# EAGLE schematic Resistor_Resistor (EAGLE 8.3.0), part 37 of 43
## Nets (continued)
N$120: R22201.2 R22202.2 R22203.2 R22204.2 R22205.2 R22206.2 R22207.2 R22208.2 R22209.2 R22210.2 R22211.2 R22212.2 R22213.2 R22214.2 R22215.2 R22216.2 R22217.2 R22218.2 R22219.2 R22220.2 R22221.2 R22222.2 R22223.2 R22224.2 R22225.2 R22226.2 R22227.2 R22228.2 R22229.2 R22230.2 R22231.2 R22232.2 R22233.2 R22234.2 R22235.2 R22236.2 R22237.2 R22238.2 R22239.2 R22240.2 R22241.2 R22242.2 R22243.2 R22244.2 R22245.2 R22246.2 R22247.2 R22248.2 R22249.2 R22250.2 R22251.2 R22252.2 R22253.2 R22254.2 R22255.2 R22256.2 R22257.2 R22258.2 R22259.2 R22260.2 R22261.2 R22262.2 R22263.2 R22264.2 R22265.2 R22266.2 R22267.2 R22268.2 R22269.2 R22270.2 R22271.2 R22272.2 R22273.2 R22274.2 R22275.2 R22276.2 R22277.2 R22278.2 R22279.2 R22280.2 R22281.2 R22282.2 R22283.2 R22284.2 R22285.2 R22286.2 R22287.2 R22288.2 R22289.2 R22290.2 R22291.2 R22292.2 R22293.2 R22294.2 R22295.2 R22296.2 R22297.2 R22298.2 R22299.2 R22300.2 R22301.2 R22302.2 R22303.2 R22304.2 R22305.2 R22306.2 R22307.2 R22308.2 R22309.2 R22310.2 R22311.2 R22312.2 R22313.2 R22314.2 R22315.2 R22316.2 R22317.2 R22318.2 R22319.2 R22320.2 R22321.2 R22322.2 R22323.2 R22324.2 R22325.2 R22326.2 R22327.2 R22328.2 R22329.2 R22330.2 R22331.2 R22332.2 R22333.2 R22334.2 R22335.2 R22336.2 R22337.2 R22338.2 R22339.2 R22340.2 R22341.2 R22342.2 R22343.2 R22344.2 R22345.2 R22346.2 R22347.2 R22348.2 R22349.2 R22350.2 R22351.2 R22352.2 R22353.2 R22354.2 R22355.2 R22356.2 R22357.2 R22358.2 R22359.2 R22360.2 R22361.2 R22362.2 R22363.2 R22364.2 R22365.2 R22366.2 R22367.2 R22368.2 R22369.2 R22370.2 R22371.2 R22372.2 R22373.2 R22374.2 R22375.2 R22376.2 R22377.2 R22378.2 R22379.2 R22380.2 R22381.2 R22382.2 R22383.2 R22384.2 R22385.2 R22386.2 R22387.2 R22388.2 R22389.2 R22390.2 R22391.2 R22392.2 R22393.2 R22394.2 R22395.2 R22396.2 R22397.2 R22398.2 R22399.2 R22400.2 R22401.1 R22402.1 R22403.1 R22404.1 R22405.1 R22406.1 R22407.1 R22408.1 R22409.1 R22410.1 R22411.1 R22412.1 R22413.1 R22414.1 R22415.1 R22416.1 R22417.1 R22418.1 R22419.1 R22420.1 R22421.1 R22422.1 R22423.1 R22424.1 R22425.1 R22426.1 R22427.1 R22428.1 R22429.1 R22430.1 R22431.1 R22432.1 R22433.1 R22434.1 R22435.1 R22436.1 R22437.1 R22438.1 R22439.1 R22440.1 R22441.1 R22442.1 R22443.1 R22444.1 R22445.1 R22446.1 R22447.1 R22448.1 R22449.1 R22450.1 R22451.1 R22452.1 R22453.1 R22454.1 R22455.1 R22456.1 R22457.1 R22458.1 R22459.1 R22460.1 R22461.1 R22462.1 R22463.1 R22464.1 R22465.1 R22466.1 R22467.1 R22468.1 R22469.1 R22470.1 R22471.1 R22472.1 R22473.1 R22474.1 R22475.1 R22476.1 R22477.1 R22478.1 R22479.1 R22480.1 R22481.1 R22482.1 R22483.1 R22484.1 R22485.1 R22486.1 R22487.1 R22488.1 R22489.1 R22490.1 R22491.1 R22492.1 R22493.1 R22494.1 R22495.1 R22496.1 R22497.1 R22498.1 R22499.1 R22500.1 R22501.1 R22502.1 R22503.1 R22504.1 R22505.1 R22506.1 R22507.1 R22508.1 R22509.1 R22510.1 R22511.1 R22512.1 R22513.1 R22514.1 R22515.1 R22516.1 R22517.1 R22518.1 R22519.1 R22520.1 R22521.1 R22522.1 R22523.1 R22524.1 R22525.1 R22526.1 R22527.1 R22528.1 R22529.1 R22530.1 R22531.1 R22532.1 R22533.1 R22534.1 R22535.1 R22536.1 R22537.1 R22538.1 R22539.1 R22540.1 R22541.1 R22542.1 R22543.1 R22544.1 R22545.1 R22546.1 R22547.1 R22548.1 R22549.1 R22550.1 R22551.1 R22552.1 R22553.1 R22554.1 R22555.1 R22556.1 R22557.1 R22558.1 R22559.1 R22560.1 R22561.1 R22562.1 R22563.1 R22564.1 R22565.1 R22566.1 R22567.1 R22568.1 R22569.1 R22570.1 R22571.1 R22572.1 R22573.1 R22574.1 R22575.1 R22576.1 R22577.1 R22578.1 R22579.1 R22580.1 R22581.1 R22582.1 R22583.1 R22584.1 R22585.1 R22586.1 R22587.1 R22588.1 R22589.1 R22590.1 R22591.1 R22592.1 R22593.1 R22594.1 R22595.1 R22596.1 R22597.1 R22598.1 R22599.1 R22600.1
N$121: R22401.2 R22402.2 R22403.2 R22404.2 R22405.2 R22406.2 R22407.2 R22408.2 R22409.2 R22410.2 R22411.2 R22412.2 R22413.2 R22414.2 R22415.2 R22416.2 R22417.2 R22418.2 R22419.2 R22420.2 R22421.2 R22422.2 R22423.2 R22424.2 R22425.2 R22426.2 R22427.2 R22428.2 R22429.2 R22430.2 R22431.2 R22432.2 R22433.2 R22434.2 R22435.2 R22436.2 R22437.2 R22438.2 R22439.2 R22440.2 R22441.2 R22442.2 R22443.2 R22444.2 R22445.2 R22446.2 R22447.2 R22448.2 R22449.2 R22450.2 R22451.2 R22452.2 R22453.2 R22454.2 R22455.2 R22456.2 R22457.2 R22458.2 R22459.2 R22460.2 R22461.2 R22462.2 R22463.2 R22464.2 R22465.2 R22466.2 R22467.2 R22468.2 R22469.2 R22470.2 R22471.2 R22472.2 R22473.2 R22474.2 R22475.2 R22476.2 R22477.2 R22478.2 R22479.2 R22480.2 R22481.2 R22482.2 R22483.2 R22484.2 R22485.2 R22486.2 R22487.2 R22488.2 R22489.2 R22490.2 R22491.2 R22492.2 R22493.2 R22494.2 R22495.2 R22496.2 R22497.2 R22498.2 R22499.2 R22500.2 R22501.2 R22502.2 R22503.2 R22504.2 R22505.2 R22506.2 R22507.2 R22508.2 R22509.2 R22510.2 R22511.2 R22512.2 R22513.2 R22514.2 R22515.2 R22516.2 R22517.2 R22518.2 R22519.2 R22520.2 R22521.2 R22522.2 R22523.2 R22524.2 R22525.2 R22526.2 R22527.2 R22528.2 R22529.2 R22530.2 R22531.2 R22532.2 R22533.2 R22534.2 R22535.2 R22536.2 R22537.2 R22538.2 R22539.2 R22540.2 R22541.2 R22542.2 R22543.2 R22544.2 R22545.2 R22546.2 R22547.2 R22548.2 R22549.2 R22550.2 R22551.2 R22552.2 R22553.2 R22554.2 R22555.2 R22556.2 R22557.2 R22558.2 R22559.2 R22560.2 R22561.2 R22562.2 R22563.2 R22564.2 R22565.2 R22566.2 R22567.2 R22568.2 R22569.2 R22570.2 R22571.2 R22572.2 R22573.2 R22574.2 R22575.2 R22576.2 R22577.2 R22578.2 R22579.2 R22580.2 R22581.2 R22582.2 R22583.2 R22584.2 R22585.2 R22586.2 R22587.2 R22588.2 R22589.2 R22590.2 R22591.2 R22592.2 R22593.2 R22594.2 R22595.2 R22596.2 R22597.2 R22598.2 R22599.2 R22600.2 R22601.1 R22602.1 R22603.1 R22604.1 R22605.1 R22606.1 R22607.1 R22608.1 R22609.1 R22610.1 R22611.1 R22612.1 R22613.1 R22614.1 R22615.1 R22616.1 R22617.1 R22618.1 R22619.1 R22620.1 R22621.1 R22622.1 R22623.1 R22624.1 R22625.1 R22626.1 R22627.1 R22628.1 R22629.1 R22630.1 R22631.1 R22632.1 R22633.1 R22634.1 R22635.1 R22636.1 R22637.1 R22638.1 R22639.1 R22640.1 R22641.1 R22642.1 R22643.1 R22644.1 R22645.1 R22646.1 R22647.1 R22648.1 R22649.1 R22650.1 R22651.1 R22652.1 R22653.1 R22654.1 R22655.1 R22656.1 R22657.1 R22658.1 R22659.1 R22660.1 R22661.1 R22662.1 R22663.1 R22664.1 R22665.1 R22666.1 R22667.1 R22668.1 R22669.1 R22670.1 R22671.1 R22672.1 R22673.1 R22674.1 R22675.1 R22676.1 R22677.1 R22678.1 R22679.1 R22680.1 R22681.1 R22682.1 R22683.1 R22684.1 R22685.1 R22686.1 R22687.1 R22688.1 R22689.1 R22690.1 R22691.1 R22692.1 R22693.1 R22694.1 R22695.1 R22696.1 R22697.1 R22698.1 R22699.1 R22700.1 R22701.1 R22702.1 R22703.1 R22704.1 R22705.1 R22706.1 R22707.1 R22708.1 R22709.1 R22710.1 R22711.1 R22712.1 R22713.1 R22714.1 R22715.1 R22716.1 R22717.1 R22718.1 R22719.1 R22720.1 R22721.1 R22722.1 R22723.1 R22724.1 R22725.1 R22726.1 R22727.1 R22728.1 R22729.1 R22730.1 R22731.1 R22732.1 R22733.1 R22734.1 R22735.1 R22736.1 R22737.1 R22738.1 R22739.1 R22740.1 R22741.1 R22742.1 R22743.1 R22744.1 R22745.1 R22746.1 R22747.1 R22748.1 R22749.1 R22750.1 R22751.1 R22752.1 R22753.1 R22754.1 R22755.1 R22756.1 R22757.1 R22758.1 R22759.1 R22760.1 R22761.1 R22762.1 R22763.1 R22764.1 R22765.1 R22766.1 R22767.1 R22768.1 R22769.1 R22770.1 R22771.1 R22772.1 R22773.1 R22774.1 R22775.1 R22776.1 R22777.1 R22778.1 R22779.1 R22780.1 R22781.1 R22782.1 R22783.1 R22784.1 R22785.1 R22786.1 R22787.1 R22788.1 R22789.1 R22790.1 R22791.1 R22792.1 R22793.1 R22794.1 R22795.1 R22796.1 R22797.1 R22798.1 R22799.1 R22800.1
N$122: R22601.2 R22602.2 R22603.2 R22604.2 R22605.2 R22606.2 R22607.2 R22608.2 R22609.2 R22610.2 R22611.2 R22612.2 R22613.2 R22614.2 R22615.2 R22616.2 R22617.2 R22618.2 R22619.2 R22620.2 R22621.2 R22622.2 R22623.2 R22624.2 R22625.2 R22626.2 R22627.2 R22628.2 R22629.2 R22630.2 R22631.2 R22632.2 R22633.2 R22634.2 R22635.2 R22636.2 R22637.2 R22638.2 R22639.2 R22640.2 R22641.2 R22642.2 R22643.2 R22644.2 R22645.2 R22646.2 R22647.2 R22648.2 R22649.2 R22650.2 R22651.2 R22652.2 R22653.2 R22654.2 R22655.2 R22656.2 R22657.2 R22658.2 R22659.2 R22660.2 R22661.2 R22662.2 R22663.2 R22664.2 R22665.2 R22666.2 R22667.2 R22668.2 R22669.2 R22670.2 R22671.2 R22672.2 R22673.2 R22674.2 R22675.2 R22676.2 R22677.2 R22678.2 R22679.2 R22680.2 R22681.2 R22682.2 R22683.2 R22684.2 R22685.2 R22686.2 R22687.2 R22688.2 R22689.2 R22690.2 R22691.2 R22692.2 R22693.2 R22694.2 R22695.2 R22696.2 R22697.2 R22698.2 R22699.2 R22700.2 R22701.2 R22702.2 R22703.2 R22704.2 R22705.2 R22706.2 R22707.2 R22708.2 R22709.2 R22710.2 R22711.2 R22712.2 R22713.2 R22714.2 R22715.2 R22716.2 R22717.2 R22718.2 R22719.2 R22720.2 R22721.2 R22722.2 R22723.2 R22724.2 R22725.2 R22726.2 R22727.2 R22728.2 R22729.2 R22730.2 R22731.2 R22732.2 R22733.2 R22734.2 R22735.2 R22736.2 R22737.2 R22738.2 R22739.2 R22740.2 R22741.2 R22742.2 R22743.2 R22744.2 R22745.2 R22746.2 R22747.2 R22748.2 R22749.2 R22750.2 R22751.2 R22752.2 R22753.2 R22754.2 R22755.2 R22756.2 R22757.2 R22758.2 R22759.2 R22760.2 R22761.2 R22762.2 R22763.2 R22764.2 R22765.2 R22766.2 R22767.2 R22768.2 R22769.2 R22770.2 R22771.2 R22772.2 R22773.2 R22774.2 R22775.2 R22776.2 R22777.2 R22778.2 R22779.2 R22780.2 R22781.2 R22782.2 R22783.2 R22784.2 R22785.2 R22786.2 R22787.2 R22788.2 R22789.2 R22790.2 R22791.2 R22792.2 R22793.2 R22794.2 R22795.2 R22796.2 R22797.2 R22798.2 R22799.2 R22800.2 R22801.1 R22802.1 R22803.1 R22804.1 R22805.1 R22806.1 R22807.1 R22808.1 R22809.1 R22810.1 R22811.1 R22812.1 R22813.1 R22814.1 R22815.1 R22816.1 R22817.1 R22818.1 R22819.1 R22820.1 R22821.1 R22822.1 R22823.1 R22824.1 R22825.1 R22826.1 R22827.1 R22828.1 R22829.1 R22830.1 R22831.1 R22832.1 R22833.1 R22834.1 R22835.1 R22836.1 R22837.1 R22838.1 R22839.1 R22840.1 R22841.1 R22842.1 R22843.1 R22844.1 R22845.1 R22846.1 R22847.1 R22848.1 R22849.1 R22850.1 R22851.1 R22852.1 R22853.1 R22854.1 R22855.1 R22856.1 R22857.1 R22858.1 R22859.1 R22860.1 R22861.1 R22862.1 R22863.1 R22864.1 R22865.1 R22866.1 R22867.1 R22868.1 R22869.1 R22870.1 R22871.1 R22872.1 R22873.1 R22874.1 R22875.1 R22876.1 R22877.1 R22878.1 R22879.1 R22880.1 R22881.1 R22882.1 R22883.1 R22884.1 R22885.1 R22886.1 R22887.1 R22888.1 R22889.1 R22890.1 R22891.1 R22892.1 R22893.1 R22894.1 R22895.1 R22896.1 R22897.1 R22898.1 R22899.1 R22900.1 R22901.1 R22902.1 R22903.1 R22904.1 R22905.1 R22906.1 R22907.1 R22908.1 R22909.1 R22910.1 R22911.1 R22912.1 R22913.1 R22914.1 R22915.1 R22916.1 R22917.1 R22918.1 R22919.1 R22920.1 R22921.1 R22922.1 R22923.1 R22924.1 R22925.1 R22926.1 R22927.1 R22928.1 R22929.1 R22930.1 R22931.1 R22932.1 R22933.1 R22934.1 R22935.1 R22936.1 R22937.1 R22938.1 R22939.1 R22940.1 R22941.1 R22942.1 R22943.1 R22944.1 R22945.1 R22946.1 R22947.1 R22948.1 R22949.1 R22950.1 R22951.1 R22952.1 R22953.1 R22954.1 R22955.1 R22956.1 R22957.1 R22958.1 R22959.1 R22960.1 R22961.1 R22962.1 R22963.1 R22964.1 R22965.1 R22966.1 R22967.1 R22968.1 R22969.1 R22970.1 R22971.1 R22972.1 R22973.1 R22974.1 R22975.1 R22976.1 R22977.1 R22978.1 R22979.1 R22980.1 R22981.1 R22982.1 R22983.1 R22984.1 R22985.1 R22986.1 R22987.1 R22988.1 R22989.1 R22990.1 R22991.1 R22992.1 R22993.1 R22994.1 R22995.1 R22996.1 R22997.1 R22998.1 R22999.1 R23000.1
N$123: R22801.2 R22802.2 R22803.2 R22804.2 R22805.2 R22806.2 R22807.2 R22808.2 R22809.2 R22810.2 R22811.2 R22812.2 R22813.2 R22814.2 R22815.2 R22816.2 R22817.2 R22818.2 R22819.2 R22820.2 R22821.2 R22822.2 R22823.2 R22824.2 R22825.2 R22826.2 R22827.2 R22828.2 R22829.2 R22830.2 R22831.2 R22832.2 R22833.2 R22834.2 R22835.2 R22836.2 R22837.2 R22838.2 R22839.2 R22840.2 R22841.2 R22842.2 R22843.2 R22844.2 R22845.2 R22846.2 R22847.2 R22848.2 R22849.2 R22850.2 R22851.2 R22852.2 R22853.2 R22854.2 R22855.2 R22856.2 R22857.2 R22858.2 R22859.2 R22860.2 R22861.2 R22862.2 R22863.2 R22864.2 R22865.2 R22866.2 R22867.2 R22868.2 R22869.2 R22870.2 R22871.2 R22872.2 R22873.2 R22874.2 R22875.2 R22876.2 R22877.2 R22878.2 R22879.2 R22880.2 R22881.2 R22882.2 R22883.2 R22884.2 R22885.2 R22886.2 R22887.2 R22888.2 R22889.2 R22890.2 R22891.2 R22892.2 R22893.2 R22894.2 R22895.2 R22896.2 R22897.2 R22898.2 R22899.2 R22900.2 R22901.2 R22902.2 R22903.2 R22904.2 R22905.2 R22906.2 R22907.2 R22908.2 R22909.2 R22910.2 R22911.2 R22912.2 R22913.2 R22914.2 R22915.2 R22916.2 R22917.2 R22918.2 R22919.2 R22920.2 R22921.2 R22922.2 R22923.2 R22924.2 R22925.2 R22926.2 R22927.2 R22928.2 R22929.2 R22930.2 R22931.2 R22932.2 R22933.2 R22934.2 R22935.2 R22936.2 R22937.2 R22938.2 R22939.2 R22940.2 R22941.2 R22942.2 R22943.2 R22944.2 R22945.2 R22946.2 R22947.2 R22948.2 R22949.2 R22950.2 R22951.2 R22952.2 R22953.2 R22954.2 R22955.2 R22956.2 R22957.2 R22958.2 R22959.2 R22960.2 R22961.2 R22962.2 R22963.2 R22964.2 R22965.2 R22966.2 R22967.2 R22968.2 R22969.2 R22970.2 R22971.2 R22972.2 R22973.2 R22974.2 R22975.2 R22976.2 R22977.2 R22978.2 R22979.2 R22980.2 R22981.2 R22982.2 R22983.2 R22984.2 R22985.2 R22986.2 R22987.2 R22988.2 R22989.2 R22990.2 R22991.2 R22992.2 R22993.2 R22994.2 R22995.2 R22996.2 R22997.2 R22998.2 R22999.2 R23000.2 R23001.1 R23002.1 R23003.1 R23004.1 R23005.1 R23006.1 R23007.1 R23008.1 R23009.1 R23010.1 R23011.1 R23012.1 R23013.1 R23014.1 R23015.1 R23016.1 R23017.1 R23018.1 R23019.1 R23020.1 R23021.1 R23022.1 R23023.1 R23024.1 R23025.1 R23026.1 R23027.1 R23028.1 R23029.1 R23030.1 R23031.1 R23032.1 R23033.1 R23034.1 R23035.1 R23036.1 R23037.1 R23038.1 R23039.1 R23040.1 R23041.1 R23042.1 R23043.1 R23044.1 R23045.1 R23046.1 R23047.1 R23048.1 R23049.1 R23050.1 R23051.1 R23052.1 R23053.1 R23054.1 R23055.1 R23056.1 R23057.1 R23058.1 R23059.1 R23060.1 R23061.1 R23062.1 R23063.1 R23064.1 R23065.1 R23066.1 R23067.1 R23068.1 R23069.1 R23070.1 R23071.1 R23072.1 R23073.1 R23074.1 R23075.1 R23076.1 R23077.1 R23078.1 R23079.1 R23080.1 R23081.1 R23082.1 R23083.1 R23084.1 R23085.1 R23086.1 R23087.1 R23088.1 R23089.1 R23090.1 R23091.1 R23092.1 R23093.1 R23094.1 R23095.1 R23096.1 R23097.1 R23098.1 R23099.1 R23100.1 R23101.1 R23102.1 R23103.1 R23104.1 R23105.1 R23106.1 R23107.1 R23108.1 R23109.1 R23110.1 R23111.1 R23112.1 R23113.1 R23114.1 R23115.1 R23116.1 R23117.1 R23118.1 R23119.1 R23120.1 R23121.1 R23122.1 R23123.1 R23124.1 R23125.1 R23126.1 R23127.1 R23128.1 R23129.1 R23130.1 R23131.1 R23132.1 R23133.1 R23134.1 R23135.1 R23136.1 R23137.1 R23138.1 R23139.1 R23140.1 R23141.1 R23142.1 R23143.1 R23144.1 R23145.1 R23146.1 R23147.1 R23148.1 R23149.1 R23150.1 R23151.1 R23152.1 R23153.1 R23154.1 R23155.1 R23156.1 R23157.1 R23158.1 R23159.1 R23160.1 R23161.1 R23162.1 R23163.1 R23164.1 R23165.1 R23166.1 R23167.1 R23168.1 R23169.1 R23170.1 R23171.1 R23172.1 R23173.1 R23174.1 R23175.1 R23176.1 R23177.1 R23178.1 R23179.1 R23180.1 R23181.1 R23182.1 R23183.1 R23184.1 R23185.1 R23186.1 R23187.1 R23188.1 R23189.1 R23190.1 R23191.1 R23192.1 R23193.1 R23194.1 R23195.1 R23196.1 R23197.1 R23198.1 R23199.1 R23200.1
N$124: R23001.2 R23002.2 R23003.2 R23004.2 R23005.2 R23006.2 R23007.2 R23008.2 R23009.2 R23010.2 R23011.2 R23012.2 R23013.2 R23014.2 R23015.2 R23016.2 R23017.2 R23018.2 R23019.2 R23020.2 R23021.2 R23022.2 R23023.2 R23024.2 R23025.2 R23026.2 R23027.2 R23028.2 R23029.2 R23030.2 R23031.2 R23032.2 R23033.2 R23034.2 R23035.2 R23036.2 R23037.2 R23038.2 R23039.2 R23040.2 R23041.2 R23042.2 R23043.2 R23044.2 R23045.2 R23046.2 R23047.2 R23048.2 R23049.2 R23050.2 R23051.2 R23052.2 R23053.2 R23054.2 R23055.2 R23056.2 R23057.2 R23058.2 R23059.2 R23060.2 R23061.2 R23062.2 R23063.2 R23064.2 R23065.2 R23066.2 R23067.2 R23068.2 R23069.2 R23070.2 R23071.2 R23072.2 R23073.2 R23074.2 R23075.2 R23076.2 R23077.2 R23078.2 R23079.2 R23080.2 R23081.2 R23082.2 R23083.2 R23084.2 R23085.2 R23086.2 R23087.2 R23088.2 R23089.2 R23090.2 R23091.2 R23092.2 R23093.2 R23094.2 R23095.2 R23096.2 R23097.2 R23098.2 R23099.2 R23100.2 R23101.2 R23102.2 R23103.2 R23104.2 R23105.2 R23106.2 R23107.2 R23108.2 R23109.2 R23110.2 R23111.2 R23112.2 R23113.2 R23114.2 R23115.2 R23116.2 R23117.2 R23118.2 R23119.2 R23120.2 R23121.2 R23122.2 R23123.2 R23124.2 R23125.2 R23126.2 R23127.2 R23128.2 R23129.2 R23130.2 R23131.2 R23132.2 R23133.2 R23134.2 R23135.2 R23136.2 R23137.2 R23138.2 R23139.2 R23140.2 R23141.2 R23142.2 R23143.2 R23144.2 R23145.2 R23146.2 R23147.2 R23148.2 R23149.2 R23150.2 R23151.2 R23152.2 R23153.2 R23154.2 R23155.2 R23156.2 R23157.2 R23158.2 R23159.2 R23160.2 R23161.2 R23162.2 R23163.2 R23164.2 R23165.2 R23166.2 R23167.2 R23168.2 R23169.2 R23170.2 R23171.2 R23172.2 R23173.2 R23174.2 R23175.2 R23176.2 R23177.2 R23178.2 R23179.2 R23180.2 R23181.2 R23182.2 R23183.2 R23184.2 R23185.2 R23186.2 R23187.2 R23188.2 R23189.2 R23190.2 R23191.2 R23192.2 R23193.2 R23194.2 R23195.2 R23196.2 R23197.2 R23198.2 R23199.2 R23200.2 R23201.1 R23202.1 R23203.1 R23204.1 R23205.1 R23206.1 R23207.1 R23208.1 R23209.1 R23210.1 R23211.1 R23212.1 R23213.1 R23214.1 R23215.1 R23216.1 R23217.1 R23218.1 R23219.1 R23220.1 R23221.1 R23222.1 R23223.1 R23224.1 R23225.1 R23226.1 R23227.1 R23228.1 R23229.1 R23230.1 R23231.1 R23232.1 R23233.1 R23234.1 R23235.1 R23236.1 R23237.1 R23238.1 R23239.1 R23240.1 R23241.1 R23242.1 R23243.1 R23244.1 R23245.1 R23246.1 R23247.1 R23248.1 R23249.1 R23250.1 R23251.1 R23252.1 R23253.1 R23254.1 R23255.1 R23256.1 R23257.1 R23258.1 R23259.1 R23260.1 R23261.1 R23262.1 R23263.1 R23264.1 R23265.1 R23266.1 R23267.1 R23268.1 R23269.1 R23270.1 R23271.1 R23272.1 R23273.1 R23274.1 R23275.1 R23276.1 R23277.1 R23278.1 R23279.1 R23280.1 R23281.1 R23282.1 R23283.1 R23284.1 R23285.1 R23286.1 R23287.1 R23288.1 R23289.1 R23290.1 R23291.1 R23292.1 R23293.1 R23294.1 R23295.1 R23296.1 R23297.1 R23298.1 R23299.1 R23300.1 R23301.1 R23302.1 R23303.1 R23304.1 R23305.1 R23306.1 R23307.1 R23308.1 R23309.1 R23310.1 R23311.1 R23312.1 R23313.1 R23314.1 R23315.1 R23316.1 R23317.1 R23318.1 R23319.1 R23320.1 R23321.1 R23322.1 R23323.1 R23324.1 R23325.1 R23326.1 R23327.1 R23328.1 R23329.1 R23330.1 R23331.1 R23332.1 R23333.1 R23334.1 R23335.1 R23336.1 R23337.1 R23338.1 R23339.1 R23340.1 R23341.1 R23342.1 R23343.1 R23344.1 R23345.1 R23346.1 R23347.1 R23348.1 R23349.1 R23350.1 R23351.1 R23352.1 R23353.1 R23354.1 R23355.1 R23356.1 R23357.1 R23358.1 R23359.1 R23360.1 R23361.1 R23362.1 R23363.1 R23364.1 R23365.1 R23366.1 R23367.1 R23368.1 R23369.1 R23370.1 R23371.1 R23372.1 R23373.1 R23374.1 R23375.1 R23376.1 R23377.1 R23378.1 R23379.1 R23380.1 R23381.1 R23382.1 R23383.1 R23384.1 R23385.1 R23386.1 R23387.1 R23388.1 R23389.1 R23390.1 R23391.1 R23392.1 R23393.1 R23394.1 R23395.1 R23396.1 R23397.1 R23398.1 R23399.1 R23400.1
N$125: R23201.2 R23202.2 R23203.2 R23204.2 R23205.2 R23206.2 R23207.2 R23208.2 R23209.2 R23210.2 R23211.2 R23212.2 R23213.2 R23214.2 R23215.2 R23216.2 R23217.2 R23218.2 R23219.2 R23220.2 R23221.2 R23222.2 R23223.2 R23224.2 R23225.2 R23226.2 R23227.2 R23228.2 R23229.2 R23230.2 R23231.2 R23232.2 R23233.2 R23234.2 R23235.2 R23236.2 R23237.2 R23238.2 R23239.2 R23240.2 R23241.2 R23242.2 R23243.2 R23244.2 R23245.2 R23246.2 R23247.2 R23248.2 R23249.2 R23250.2 R23251.2 R23252.2 R23253.2 R23254.2 R23255.2 R23256.2 R23257.2 R23258.2 R23259.2 R23260.2 R23261.2 R23262.2 R23263.2 R23264.2 R23265.2 R23266.2 R23267.2 R23268.2 R23269.2 R23270.2 R23271.2 R23272.2 R23273.2 R23274.2 R23275.2 R23276.2 R23277.2 R23278.2 R23279.2 R23280.2 R23281.2 R23282.2 R23283.2 R23284.2 R23285.2 R23286.2 R23287.2 R23288.2 R23289.2 R23290.2 R23291.2 R23292.2 R23293.2 R23294.2 R23295.2 R23296.2 R23297.2 R23298.2 R23299.2 R23300.2 R23301.2 R23302.2 R23303.2 R23304.2 R23305.2 R23306.2 R23307.2 R23308.2 R23309.2 R23310.2 R23311.2 R23312.2 R23313.2 R23314.2 R23315.2 R23316.2 R23317.2 R23318.2 R23319.2 R23320.2 R23321.2 R23322.2 R23323.2 R23324.2 R23325.2 R23326.2 R23327.2 R23328.2 R23329.2 R23330.2 R23331.2 R23332.2 R23333.2 R23334.2 R23335.2 R23336.2 R23337.2 R23338.2 R23339.2 R23340.2 R23341.2 R23342.2 R23343.2 R23344.2 R23345.2 R23346.2 R23347.2 R23348.2 R23349.2 R23350.2 R23351.2 R23352.2 R23353.2 R23354.2 R23355.2 R23356.2 R23357.2 R23358.2 R23359.2 R23360.2 R23361.2 R23362.2 R23363.2 R23364.2 R23365.2 R23366.2 R23367.2 R23368.2 R23369.2 R23370.2 R23371.2 R23372.2 R23373.2 R23374.2 R23375.2 R23376.2 R23377.2 R23378.2 R23379.2 R23380.2 R23381.2 R23382.2 R23383.2 R23384.2 R23385.2 R23386.2 R23387.2 R23388.2 R23389.2 R23390.2 R23391.2 R23392.2 R23393.2 R23394.2 R23395.2 R23396.2 R23397.2 R23398.2 R23399.2 R23400.2 R23401.1 R23402.1 R23403.1 R23404.1 R23405.1 R23406.1 R23407.1 R23408.1 R23409.1 R23410.1 R23411.1 R23412.1 R23413.1 R23414.1 R23415.1 R23416.1 R23417.1 R23418.1 R23419.1 R23420.1 R23421.1 R23422.1 R23423.1 R23424.1 R23425.1 R23426.1 R23427.1 R23428.1 R23429.1 R23430.1 R23431.1 R23432.1 R23433.1 R23434.1 R23435.1 R23436.1 R23437.1 R23438.1 R23439.1 R23440.1 R23441.1 R23442.1 R23443.1 R23444.1 R23445.1 R23446.1 R23447.1 R23448.1 R23449.1 R23450.1 R23451.1 R23452.1 R23453.1 R23454.1 R23455.1 R23456.1 R23457.1 R23458.1 R23459.1 R23460.1 R23461.1 R23462.1 R23463.1 R23464.1 R23465.1 R23466.1 R23467.1 R23468.1 R23469.1 R23470.1 R23471.1 R23472.1 R23473.1 R23474.1 R23475.1 R23476.1 R23477.1 R23478.1 R23479.1 R23480.1 R23481.1 R23482.1 R23483.1 R23484.1 R23485.1 R23486.1 R23487.1 R23488.1 R23489.1 R23490.1 R23491.1 R23492.1 R23493.1 R23494.1 R23495.1 R23496.1 R23497.1 R23498.1 R23499.1 R23500.1 R23501.1 R23502.1 R23503.1 R23504.1 R23505.1 R23506.1 R23507.1 R23508.1 R23509.1 R23510.1 R23511.1 R23512.1 R23513.1 R23514.1 R23515.1 R23516.1 R23517.1 R23518.1 R23519.1 R23520.1 R23521.1 R23522.1 R23523.1 R23524.1 R23525.1 R23526.1 R23527.1 R23528.1 R23529.1 R23530.1 R23531.1 R23532.1 R23533.1 R23534.1 R23535.1 R23536.1 R23537.1 R23538.1 R23539.1 R23540.1 R23541.1 R23542.1 R23543.1 R23544.1 R23545.1 R23546.1 R23547.1 R23548.1 R23549.1 R23550.1 R23551.1 R23552.1 R23553.1 R23554.1 R23555.1 R23556.1 R23557.1 R23558.1 R23559.1 R23560.1 R23561.1 R23562.1 R23563.1 R23564.1 R23565.1 R23566.1 R23567.1 R23568.1 R23569.1 R23570.1 R23571.1 R23572.1 R23573.1 R23574.1 R23575.1 R23576.1 R23577.1 R23578.1 R23579.1 R23580.1 R23581.1 R23582.1 R23583.1 R23584.1 R23585.1 R23586.1 R23587.1 R23588.1 R23589.1 R23590.1 R23591.1 R23592.1 R23593.1 R23594.1 R23595.1 R23596.1 R23597.1 R23598.1 R23599.1 R23600.1
N$126: R23401.2 R23402.2 R23403.2 R23404.2 R23405.2 R23406.2 R23407.2 R23408.2 R23409.2 R23410.2 R23411.2 R23412.2 R23413.2 R23414.2 R23415.2 R23416.2 R23417.2 R23418.2 R23419.2 R23420.2 R23421.2 R23422.2 R23423.2 R23424.2 R23425.2 R23426.2 R23427.2 R23428.2 R23429.2 R23430.2 R23431.2 R23432.2 R23433.2 R23434.2 R23435.2 R23436.2 R23437.2 R23438.2 R23439.2 R23440.2 R23441.2 R23442.2 R23443.2 R23444.2 R23445.2 R23446.2 R23447.2 R23448.2 R23449.2 R23450.2 R23451.2 R23452.2 R23453.2 R23454.2 R23455.2 R23456.2 R23457.2 R23458.2 R23459.2 R23460.2 R23461.2 R23462.2 R23463.2 R23464.2 R23465.2 R23466.2 R23467.2 R23468.2 R23469.2 R23470.2 R23471.2 R23472.2 R23473.2 R23474.2 R23475.2 R23476.2 R23477.2 R23478.2 R23479.2 R23480.2 R23481.2 R23482.2 R23483.2 R23484.2 R23485.2 R23486.2 R23487.2 R23488.2 R23489.2 R23490.2 R23491.2 R23492.2 R23493.2 R23494.2 R23495.2 R23496.2 R23497.2 R23498.2 R23499.2 R23500.2 R23501.2 R23502.2 R23503.2 R23504.2 R23505.2 R23506.2 R23507.2 R23508.2 R23509.2 R23510.2 R23511.2 R23512.2 R23513.2 R23514.2 R23515.2 R23516.2 R23517.2 R23518.2 R23519.2 R23520.2 R23521.2 R23522.2 R23523.2 R23524.2 R23525.2 R23526.2 R23527.2 R23528.2 R23529.2 R23530.2 R23531.2 R23532.2 R23533.2 R23534.2 R23535.2 R23536.2 R23537.2 R23538.2 R23539.2 R23540.2 R23541.2 R23542.2 R23543.2 R23544.2 R23545.2 R23546.2 R23547.2 R23548.2 R23549.2 R23550.2 R23551.2 R23552.2 R23553.2 R23554.2 R23555.2 R23556.2 R23557.2 R23558.2 R23559.2 R23560.2 R23561.2 R23562.2 R23563.2 R23564.2 R23565.2 R23566.2 R23567.2 R23568.2 R23569.2 R23570.2 R23571.2 R23572.2 R23573.2 R23574.2 R23575.2 R23576.2 R23577.2 R23578.2 R23579.2 R23580.2 R23581.2 R23582.2 R23583.2 R23584.2 R23585.2 R23586.2 R23587.2 R23588.2 R23589.2 R23590.2 R23591.2 R23592.2 R23593.2 R23594.2 R23595.2 R23596.2 R23597.2 R23598.2 R23599.2 R23600.2 R23601.1 R23602.1 R23603.1 R23604.1 R23605.1 R23606.1 R23607.1 R23608.1 R23609.1 R23610.1 R23611.1 R23612.1 R23613.1 R23614.1 R23615.1 R23616.1 R23617.1 R23618.1 R23619.1 R23620.1 R23621.1 R23622.1 R23623.1 R23624.1 R23625.1 R23626.1 R23627.1 R23628.1 R23629.1 R23630.1 R23631.1 R23632.1 R23633.1 R23634.1 R23635.1 R23636.1 R23637.1 R23638.1 R23639.1 R23640.1 R23641.1 R23642.1 R23643.1 R23644.1 R23645.1 R23646.1 R23647.1 R23648.1 R23649.1 R23650.1 R23651.1 R23652.1 R23653.1 R23654.1 R23655.1 R23656.1 R23657.1 R23658.1 R23659.1 R23660.1 R23661.1 R23662.1 R23663.1 R23664.1 R23665.1 R23666.1 R23667.1 R23668.1 R23669.1 R23670.1 R23671.1 R23672.1 R23673.1 R23674.1 R23675.1 R23676.1 R23677.1 R23678.1 R23679.1 R23680.1 R23681.1 R23682.1 R23683.1 R23684.1 R23685.1 R23686.1 R23687.1 R23688.1 R23689.1 R23690.1 R23691.1 R23692.1 R23693.1 R23694.1 R23695.1 R23696.1 R23697.1 R23698.1 R23699.1 R23700.1 R23701.1 R23702.1 R23703.1 R23704.1 R23705.1 R23706.1 R23707.1 R23708.1 R23709.1 R23710.1 R23711.1 R23712.1 R23713.1 R23714.1 R23715.1 R23716.1 R23717.1 R23718.1 R23719.1 R23720.1 R23721.1 R23722.1 R23723.1 R23724.1 R23725.1 R23726.1 R23727.1 R23728.1 R23729.1 R23730.1 R23731.1 R23732.1 R23733.1 R23734.1 R23735.1 R23736.1 R23737.1 R23738.1 R23739.1 R23740.1 R23741.1 R23742.1 R23743.1 R23744.1 R23745.1 R23746.1 R23747.1 R23748.1 R23749.1 R23750.1 R23751.1 R23752.1 R23753.1 R23754.1 R23755.1 R23756.1 R23757.1 R23758.1 R23759.1 R23760.1 R23761.1 R23762.1 R23763.1 R23764.1 R23765.1 R23766.1 R23767.1 R23768.1 R23769.1 R23770.1 R23771.1 R23772.1 R23773.1 R23774.1 R23775.1 R23776.1 R23777.1 R23778.1 R23779.1 R23780.1 R23781.1 R23782.1 R23783.1 R23784.1 R23785.1 R23786.1 R23787.1 R23788.1 R23789.1 R23790.1 R23791.1 R23792.1 R23793.1 R23794.1 R23795.1 R23796.1 R23797.1 R23798.1 R23799.1 R23800.1
N$127: R23601.2 R23602.2 R23603.2 R23604.2 R23605.2 R23606.2 R23607.2 R23608.2 R23609.2 R23610.2 R23611.2 R23612.2 R23613.2 R23614.2 R23615.2 R23616.2 R23617.2 R23618.2 R23619.2 R23620.2 R23621.2 R23622.2 R23623.2 R23624.2 R23625.2 R23626.2 R23627.2 R23628.2 R23629.2 R23630.2 R23631.2 R23632.2 R23633.2 R23634.2 R23635.2 R23636.2 R23637.2 R23638.2 R23639.2 R23640.2 R23641.2 R23642.2 R23643.2 R23644.2 R23645.2 R23646.2 R23647.2 R23648.2 R23649.2 R23650.2 R23651.2 R23652.2 R23653.2 R23654.2 R23655.2 R23656.2 R23657.2 R23658.2 R23659.2 R23660.2 R23661.2 R23662.2 R23663.2 R23664.2 R23665.2 R23666.2 R23667.2 R23668.2 R23669.2 R23670.2 R23671.2 R23672.2 R23673.2 R23674.2 R23675.2 R23676.2 R23677.2 R23678.2 R23679.2 R23680.2 R23681.2 R23682.2 R23683.2 R23684.2 R23685.2 R23686.2 R23687.2 R23688.2 R23689.2 R23690.2 R23691.2 R23692.2 R23693.2 R23694.2 R23695.2 R23696.2 R23697.2 R23698.2 R23699.2 R23700.2 R23701.2 R23702.2 R23703.2 R23704.2 R23705.2 R23706.2 R23707.2 R23708.2 R23709.2 R23710.2 R23711.2 R23712.2 R23713.2 R23714.2 R23715.2 R23716.2 R23717.2 R23718.2 R23719.2 R23720.2 R23721.2 R23722.2 R23723.2 R23724.2 R23725.2 R23726.2 R23727.2 R23728.2 R23729.2 R23730.2 R23731.2 R23732.2 R23733.2 R23734.2 R23735.2 R23736.2 R23737.2 R23738.2 R23739.2 R23740.2 R23741.2 R23742.2 R23743.2 R23744.2 R23745.2 R23746.2 R23747.2 R23748.2 R23749.2 R23750.2 R23751.2 R23752.2 R23753.2 R23754.2 R23755.2 R23756.2 R23757.2 R23758.2 R23759.2 R23760.2 R23761.2 R23762.2 R23763.2 R23764.2 R23765.2 R23766.2 R23767.2 R23768.2 R23769.2 R23770.2 R23771.2 R23772.2 R23773.2 R23774.2 R23775.2 R23776.2 R23777.2 R23778.2 R23779.2 R23780.2 R23781.2 R23782.2 R23783.2 R23784.2 R23785.2 R23786.2 R23787.2 R23788.2 R23789.2 R23790.2 R23791.2 R23792.2 R23793.2 R23794.2 R23795.2 R23796.2 R23797.2 R23798.2 R23799.2 R23800.2 R23801.1 R23802.1 R23803.1 R23804.1 R23805.1 R23806.1 R23807.1 R23808.1 R23809.1 R23810.1 R23811.1 R23812.1 R23813.1 R23814.1 R23815.1 R23816.1 R23817.1 R23818.1 R23819.1 R23820.1 R23821.1 R23822.1 R23823.1 R23824.1 R23825.1 R23826.1 R23827.1 R23828.1 R23829.1 R23830.1 R23831.1 R23832.1 R23833.1 R23834.1 R23835.1 R23836.1 R23837.1 R23838.1 R23839.1 R23840.1 R23841.1 R23842.1 R23843.1 R23844.1 R23845.1 R23846.1 R23847.1 R23848.1 R23849.1 R23850.1 R23851.1 R23852.1 R23853.1 R23854.1 R23855.1 R23856.1 R23857.1 R23858.1 R23859.1 R23860.1 R23861.1 R23862.1 R23863.1 R23864.1 R23865.1 R23866.1 R23867.1 R23868.1 R23869.1 R23870.1 R23871.1 R23872.1 R23873.1 R23874.1 R23875.1 R23876.1 R23877.1 R23878.1 R23879.1 R23880.1 R23881.1 R23882.1 R23883.1 R23884.1 R23885.1 R23886.1 R23887.1 R23888.1 R23889.1 R23890.1 R23891.1 R23892.1 R23893.1 R23894.1 R23895.1 R23896.1 R23897.1 R23898.1 R23899.1 R23900.1 R23901.1 R23902.1 R23903.1 R23904.1 R23905.1 R23906.1 R23907.1 R23908.1 R23909.1 R23910.1 R23911.1 R23912.1 R23913.1 R23914.1 R23915.1 R23916.1 R23917.1 R23918.1 R23919.1 R23920.1 R23921.1 R23922.1 R23923.1 R23924.1 R23925.1 R23926.1 R23927.1 R23928.1 R23929.1 R23930.1 R23931.1 R23932.1 R23933.1 R23934.1 R23935.1 R23936.1 R23937.1 R23938.1 R23939.1 R23940.1 R23941.1 R23942.1 R23943.1 R23944.1 R23945.1 R23946.1 R23947.1 R23948.1 R23949.1 R23950.1 R23951.1 R23952.1 R23953.1 R23954.1 R23955.1 R23956.1 R23957.1 R23958.1 R23959.1 R23960.1 R23961.1 R23962.1 R23963.1 R23964.1 R23965.1 R23966.1 R23967.1 R23968.1 R23969.1 R23970.1 R23971.1 R23972.1 R23973.1 R23974.1 R23975.1 R23976.1 R23977.1 R23978.1 R23979.1 R23980.1 R23981.1 R23982.1 R23983.1 R23984.1 R23985.1 R23986.1 R23987.1 R23988.1 R23989.1 R23990.1 R23991.1 R23992.1 R23993.1 R23994.1 R23995.1 R23996.1 R23997.1 R23998.1 R23999.1 R24000.1
N$128: R23801.2 R23802.2 R23803.2 R23804.2 R23805.2 R23806.2 R23807.2 R23808.2 R23809.2 R23810.2 R23811.2 R23812.2 R23813.2 R23814.2 R23815.2 R23816.2 R23817.2 R23818.2 R23819.2 R23820.2 R23821.2 R23822.2 R23823.2 R23824.2 R23825.2 R23826.2 R23827.2 R23828.2 R23829.2 R23830.2 R23831.2 R23832.2 R23833.2 R23834.2 R23835.2 R23836.2 R23837.2 R23838.2 R23839.2 R23840.2 R23841.2 R23842.2 R23843.2 R23844.2 R23845.2 R23846.2 R23847.2 R23848.2 R23849.2 R23850.2 R23851.2 R23852.2 R23853.2 R23854.2 R23855.2 R23856.2 R23857.2 R23858.2 R23859.2 R23860.2 R23861.2 R23862.2 R23863.2 R23864.2 R23865.2 R23866.2 R23867.2 R23868.2 R23869.2 R23870.2 R23871.2 R23872.2 R23873.2 R23874.2 R23875.2 R23876.2 R23877.2 R23878.2 R23879.2 R23880.2 R23881.2 R23882.2 R23883.2 R23884.2 R23885.2 R23886.2 R23887.2 R23888.2 R23889.2 R23890.2 R23891.2 R23892.2 R23893.2 R23894.2 R23895.2 R23896.2 R23897.2 R23898.2 R23899.2 R23900.2 R23901.2 R23902.2 R23903.2 R23904.2 R23905.2 R23906.2 R23907.2 R23908.2 R23909.2 R23910.2 R23911.2 R23912.2 R23913.2 R23914.2 R23915.2 R23916.2 R23917.2 R23918.2 R23919.2 R23920.2 R23921.2 R23922.2 R23923.2 R23924.2 R23925.2 R23926.2 R23927.2 R23928.2 R23929.2 R23930.2 R23931.2 R23932.2 R23933.2 R23934.2 R23935.2 R23936.2 R23937.2 R23938.2 R23939.2 R23940.2 R23941.2 R23942.2 R23943.2 R23944.2 R23945.2 R23946.2 R23947.2 R23948.2 R23949.2 R23950.2 R23951.2 R23952.2 R23953.2 R23954.2 R23955.2 R23956.2 R23957.2 R23958.2 R23959.2 R23960.2 R23961.2 R23962.2 R23963.2 R23964.2 R23965.2 R23966.2 R23967.2 R23968.2 R23969.2 R23970.2 R23971.2 R23972.2 R23973.2 R23974.2 R23975.2 R23976.2 R23977.2 R23978.2 R23979.2 R23980.2 R23981.2 R23982.2 R23983.2 R23984.2 R23985.2 R23986.2 R23987.2 R23988.2 R23989.2 R23990.2 R23991.2 R23992.2 R23993.2 R23994.2 R23995.2 R23996.2 R23997.2 R23998.2 R23999.2 R24000.2 R24001.1 R24002.1 R24003.1 R24004.1 R24005.1 R24006.1 R24007.1 R24008.1 R24009.1 R24010.1 R24011.1 R24012.1 R24013.1 R24014.1 R24015.1 R24016.1 R24017.1 R24018.1 R24019.1 R24020.1 R24021.1 R24022.1 R24023.1 R24024.1 R24025.1 R24026.1 R24027.1 R24028.1 R24029.1 R24030.1 R24031.1 R24032.1 R24033.1 R24034.1 R24035.1 R24036.1 R24037.1 R24038.1 R24039.1 R24040.1 R24041.1 R24042.1 R24043.1 R24044.1 R24045.1 R24046.1 R24047.1 R24048.1 R24049.1 R24050.1 R24051.1 R24052.1 R24053.1 R24054.1 R24055.1 R24056.1 R24057.1 R24058.1 R24059.1 R24060.1 R24061.1 R24062.1 R24063.1 R24064.1 R24065.1 R24066.1 R24067.1 R24068.1 R24069.1 R24070.1 R24071.1 R24072.1 R24073.1 R24074.1 R24075.1 R24076.1 R24077.1 R24078.1 R24079.1 R24080.1 R24081.1 R24082.1 R24083.1 R24084.1 R24085.1 R24086.1 R24087.1 R24088.1 R24089.1 R24090.1 R24091.1 R24092.1 R24093.1 R24094.1 R24095.1 R24096.1 R24097.1 R24098.1 R24099.1 R24100.1 R24101.1 R24102.1 R24103.1 R24104.1 R24105.1 R24106.1 R24107.1 R24108.1 R24109.1 R24110.1 R24111.1 R24112.1 R24113.1 R24114.1 R24115.1 R24116.1 R24117.1 R24118.1 R24119.1 R24120.1 R24121.1 R24122.1 R24123.1 R24124.1 R24125.1 R24126.1 R24127.1 R24128.1 R24129.1 R24130.1 R24131.1 R24132.1 R24133.1 R24134.1 R24135.1 R24136.1 R24137.1 R24138.1 R24139.1 R24140.1 R24141.1 R24142.1 R24143.1 R24144.1 R24145.1 R24146.1 R24147.1 R24148.1 R24149.1 R24150.1 R24151.1 R24152.1 R24153.1 R24154.1 R24155.1 R24156.1 R24157.1 R24158.1 R24159.1 R24160.1 R24161.1 R24162.1 R24163.1 R24164.1 R24165.1 R24166.1 R24167.1 R24168.1 R24169.1 R24170.1 R24171.1 R24172.1 R24173.1 R24174.1 R24175.1 R24176.1 R24177.1 R24178.1 R24179.1 R24180.1 R24181.1 R24182.1 R24183.1 R24184.1 R24185.1 R24186.1 R24187.1 R24188.1 R24189.1 R24190.1 R24191.1 R24192.1 R24193.1 R24194.1 R24195.1 R24196.1 R24197.1 R24198.1 R24199.1 R24200.1
N$129: R24001.2 R24002.2 R24003.2 R24004.2 R24005.2 R24006.2 R24007.2 R24008.2 R24009.2 R24010.2 R24011.2 R24012.2 R24013.2 R24014.2 R24015.2 R24016.2 R24017.2 R24018.2 R24019.2 R24020.2 R24021.2 R24022.2 R24023.2 R24024.2 R24025.2 R24026.2 R24027.2 R24028.2 R24029.2 R24030.2 R24031.2 R24032.2 R24033.2 R24034.2 R24035.2 R24036.2 R24037.2 R24038.2 R24039.2 R24040.2 R24041.2 R24042.2 R24043.2 R24044.2 R24045.2 R24046.2 R24047.2 R24048.2 R24049.2 R24050.2 R24051.2 R24052.2 R24053.2 R24054.2 R24055.2 R24056.2 R24057.2 R24058.2 R24059.2 R24060.2 R24061.2 R24062.2 R24063.2 R24064.2 R24065.2 R24066.2 R24067.2 R24068.2 R24069.2 R24070.2 R24071.2 R24072.2 R24073.2 R24074.2 R24075.2 R24076.2 R24077.2 R24078.2 R24079.2 R24080.2 R24081.2 R24082.2 R24083.2 R24084.2 R24085.2 R24086.2 R24087.2 R24088.2 R24089.2 R24090.2 R24091.2 R24092.2 R24093.2 R24094.2 R24095.2 R24096.2 R24097.2 R24098.2 R24099.2 R24100.2 R24101.2 R24102.2 R24103.2 R24104.2 R24105.2 R24106.2 R24107.2 R24108.2 R24109.2 R24110.2 R24111.2 R24112.2 R24113.2 R24114.2 R24115.2 R24116.2 R24117.2 R24118.2 R24119.2 R24120.2 R24121.2 R24122.2 R24123.2 R24124.2 R24125.2 R24126.2 R24127.2 R24128.2 R24129.2 R24130.2 R24131.2 R24132.2 R24133.2 R24134.2 R24135.2 R24136.2 R24137.2 R24138.2 R24139.2 R24140.2 R24141.2 R24142.2 R24143.2 R24144.2 R24145.2 R24146.2 R24147.2 R24148.2 R24149.2 R24150.2 R24151.2 R24152.2 R24153.2 R24154.2 R24155.2 R24156.2 R24157.2 R24158.2 R24159.2 R24160.2 R24161.2 R24162.2 R24163.2 R24164.2 R24165.2 R24166.2 R24167.2 R24168.2 R24169.2 R24170.2 R24171.2 R24172.2 R24173.2 R24174.2 R24175.2 R24176.2 R24177.2 R24178.2 R24179.2 R24180.2 R24181.2 R24182.2 R24183.2 R24184.2 R24185.2 R24186.2 R24187.2 R24188.2 R24189.2 R24190.2 R24191.2 R24192.2 R24193.2 R24194.2 R24195.2 R24196.2 R24197.2 R24198.2 R24199.2 R24200.2 R24201.1 R24202.1 R24203.1 R24204.1 R24205.1 R24206.1 R24207.1 R24208.1 R24209.1 R24210.1 R24211.1 R24212.1 R24213.1 R24214.1 R24215.1 R24216.1 R24217.1 R24218.1 R24219.1 R24220.1 R24221.1 R24222.1 R24223.1 R24224.1 R24225.1 R24226.1 R24227.1 R24228.1 R24229.1 R24230.1 R24231.1 R24232.1 R24233.1 R24234.1 R24235.1 R24236.1 R24237.1 R24238.1 R24239.1 R24240.1 R24241.1 R24242.1 R24243.1 R24244.1 R24245.1 R24246.1 R24247.1 R24248.1 R24249.1 R24250.1 R24251.1 R24252.1 R24253.1 R24254.1 R24255.1 R24256.1 R24257.1 R24258.1 R24259.1 R24260.1 R24261.1 R24262.1 R24263.1 R24264.1 R24265.1 R24266.1 R24267.1 R24268.1 R24269.1 R24270.1 R24271.1 R24272.1 R24273.1 R24274.1 R24275.1 R24276.1 R24277.1 R24278.1 R24279.1 R24280.1 R24281.1 R24282.1 R24283.1 R24284.1 R24285.1 R24286.1 R24287.1 R24288.1 R24289.1 R24290.1 R24291.1 R24292.1 R24293.1 R24294.1 R24295.1 R24296.1 R24297.1 R24298.1 R24299.1 R24300.1 R24301.1 R24302.1 R24303.1 R24304.1 R24305.1 R24306.1 R24307.1 R24308.1 R24309.1 R24310.1 R24311.1 R24312.1 R24313.1 R24314.1 R24315.1 R24316.1 R24317.1 R24318.1 R24319.1 R24320.1 R24321.1 R24322.1 R24323.1 R24324.1 R24325.1 R24326.1 R24327.1 R24328.1 R24329.1 R24330.1 R24331.1 R24332.1 R24333.1 R24334.1 R24335.1 R24336.1 R24337.1 R24338.1 R24339.1 R24340.1 R24341.1 R24342.1 R24343.1 R24344.1 R24345.1 R24346.1 R24347.1 R24348.1 R24349.1 R24350.1 R24351.1 R24352.1 R24353.1 R24354.1 R24355.1 R24356.1 R24357.1 R24358.1 R24359.1 R24360.1 R24361.1 R24362.1 R24363.1 R24364.1 R24365.1 R24366.1 R24367.1 R24368.1 R24369.1 R24370.1 R24371.1 R24372.1 R24373.1 R24374.1 R24375.1 R24376.1 R24377.1 R24378.1 R24379.1 R24380.1 R24381.1 R24382.1 R24383.1 R24384.1 R24385.1 R24386.1 R24387.1 R24388.1 R24389.1 R24390.1 R24391.1 R24392.1 R24393.1 R24394.1 R24395.1 R24396.1 R24397.1 R24398.1 R24399.1 R24400.1
N$130: R24201.2 R24202.2 R24203.2 R24204.2 R24205.2 R24206.2 R24207.2 R24208.2 R24209.2 R24210.2 R24211.2 R24212.2 R24213.2 R24214.2 R24215.2 R24216.2 R24217.2 R24218.2 R24219.2 R24220.2 R24221.2 R24222.2 R24223.2 R24224.2 R24225.2 R24226.2 R24227.2 R24228.2 R24229.2 R24230.2 R24231.2 R24232.2 R24233.2 R24234.2 R24235.2 R24236.2 R24237.2 R24238.2 R24239.2 R24240.2 R24241.2 R24242.2 R24243.2 R24244.2 R24245.2 R24246.2 R24247.2 R24248.2 R24249.2 R24250.2 R24251.2 R24252.2 R24253.2 R24254.2 R24255.2 R24256.2 R24257.2 R24258.2 R24259.2 R24260.2 R24261.2 R24262.2 R24263.2 R24264.2 R24265.2 R24266.2 R24267.2 R24268.2 R24269.2 R24270.2 R24271.2 R24272.2 R24273.2 R24274.2 R24275.2 R24276.2 R24277.2 R24278.2 R24279.2 R24280.2 R24281.2 R24282.2 R24283.2 R24284.2 R24285.2 R24286.2 R24287.2 R24288.2 R24289.2 R24290.2 R24291.2 R24292.2 R24293.2 R24294.2 R24295.2 R24296.2 R24297.2 R24298.2 R24299.2 R24300.2 R24301.2 R24302.2 R24303.2 R24304.2 R24305.2 R24306.2 R24307.2 R24308.2 R24309.2 R24310.2 R24311.2 R24312.2 R24313.2 R24314.2 R24315.2 R24316.2 R24317.2 R24318.2 R24319.2 R24320.2 R24321.2 R24322.2 R24323.2 R24324.2 R24325.2 R24326.2 R24327.2 R24328.2 R24329.2 R24330.2 R24331.2 R24332.2 R24333.2 R24334.2 R24335.2 R24336.2 R24337.2 R24338.2 R24339.2 R24340.2 R24341.2 R24342.2 R24343.2 R24344.2 R24345.2 R24346.2 R24347.2 R24348.2 R24349.2 R24350.2 R24351.2 R24352.2 R24353.2 R24354.2 R24355.2 R24356.2 R24357.2 R24358.2 R24359.2 R24360.2 R24361.2 R24362.2 R24363.2 R24364.2 R24365.2 R24366.2 R24367.2 R24368.2 R24369.2 R24370.2 R24371.2 R24372.2 R24373.2 R24374.2 R24375.2 R24376.2 R24377.2 R24378.2 R24379.2 R24380.2 R24381.2 R24382.2 R24383.2 R24384.2 R24385.2 R24386.2 R24387.2 R24388.2 R24389.2 R24390.2 R24391.2 R24392.2 R24393.2 R24394.2 R24395.2 R24396.2 R24397.2 R24398.2 R24399.2 R24400.2 R24401.1 R24402.1 R24403.1 R24404.1 R24405.1 R24406.1 R24407.1 R24408.1 R24409.1 R24410.1 R24411.1 R24412.1 R24413.1 R24414.1 R24415.1 R24416.1 R24417.1 R24418.1 R24419.1 R24420.1 R24421.1 R24422.1 R24423.1 R24424.1 R24425.1 R24426.1 R24427.1 R24428.1 R24429.1 R24430.1 R24431.1 R24432.1 R24433.1 R24434.1 R24435.1 R24436.1 R24437.1 R24438.1 R24439.1 R24440.1 R24441.1 R24442.1 R24443.1 R24444.1 R24445.1 R24446.1 R24447.1 R24448.1 R24449.1 R24450.1 R24451.1 R24452.1 R24453.1 R24454.1 R24455.1 R24456.1 R24457.1 R24458.1 R24459.1 R24460.1 R24461.1 R24462.1 R24463.1 R24464.1 R24465.1 R24466.1 R24467.1 R24468.1 R24469.1 R24470.1 R24471.1 R24472.1 R24473.1 R24474.1 R24475.1 R24476.1 R24477.1 R24478.1 R24479.1 R24480.1 R24481.1 R24482.1 R24483.1 R24484.1 R24485.1 R24486.1 R24487.1 R24488.1 R24489.1 R24490.1 R24491.1 R24492.1 R24493.1 R24494.1 R24495.1 R24496.1 R24497.1 R24498.1 R24499.1 R24500.1 R24501.1 R24502.1 R24503.1 R24504.1 R24505.1 R24506.1 R24507.1 R24508.1 R24509.1 R24510.1 R24511.1 R24512.1 R24513.1 R24514.1 R24515.1 R24516.1 R24517.1 R24518.1 R24519.1 R24520.1 R24521.1 R24522.1 R24523.1 R24524.1 R24525.1 R24526.1 R24527.1 R24528.1 R24529.1 R24530.1 R24531.1 R24532.1 R24533.1 R24534.1 R24535.1 R24536.1 R24537.1 R24538.1 R24539.1 R24540.1 R24541.1 R24542.1 R24543.1 R24544.1 R24545.1 R24546.1 R24547.1 R24548.1 R24549.1 R24550.1 R24551.1 R24552.1 R24553.1 R24554.1 R24555.1 R24556.1 R24557.1 R24558.1 R24559.1 R24560.1 R24561.1 R24562.1 R24563.1 R24564.1 R24565.1 R24566.1 R24567.1 R24568.1 R24569.1 R24570.1 R24571.1 R24572.1 R24573.1 R24574.1 R24575.1 R24576.1 R24577.1 R24578.1 R24579.1 R24580.1 R24581.1 R24582.1 R24583.1 R24584.1 R24585.1 R24586.1 R24587.1 R24588.1 R24589.1 R24590.1 R24591.1 R24592.1 R24593.1 R24594.1 R24595.1 R24596.1 R24597.1 R24598.1 R24599.1 R24600.1
N$131: R24401.2 R24402.2 R24403.2 R24404.2 R24405.2 R24406.2 R24407.2 R24408.2 R24409.2 R24410.2 R24411.2 R24412.2 R24413.2 R24414.2 R24415.2 R24416.2 R24417.2 R24418.2 R24419.2 R24420.2 R24421.2 R24422.2 R24423.2 R24424.2 R24425.2 R24426.2 R24427.2 R24428.2 R24429.2 R24430.2 R24431.2 R24432.2 R24433.2 R24434.2 R24435.2 R24436.2 R24437.2 R24438.2 R24439.2 R24440.2 R24441.2 R24442.2 R24443.2 R24444.2 R24445.2 R24446.2 R24447.2 R24448.2 R24449.2 R24450.2 R24451.2 R24452.2 R24453.2 R24454.2 R24455.2 R24456.2 R24457.2 R24458.2 R24459.2 R24460.2 R24461.2 R24462.2 R24463.2 R24464.2 R24465.2 R24466.2 R24467.2 R24468.2 R24469.2 R24470.2 R24471.2 R24472.2 R24473.2 R24474.2 R24475.2 R24476.2 R24477.2 R24478.2 R24479.2 R24480.2 R24481.2 R24482.2 R24483.2 R24484.2 R24485.2 R24486.2 R24487.2 R24488.2 R24489.2 R24490.2 R24491.2 R24492.2 R24493.2 R24494.2 R24495.2 R24496.2 R24497.2 R24498.2 R24499.2 R24500.2 R24501.2 R24502.2 R24503.2 R24504.2 R24505.2 R24506.2 R24507.2 R24508.2 R24509.2 R24510.2 R24511.2 R24512.2 R24513.2 R24514.2 R24515.2 R24516.2 R24517.2 R24518.2 R24519.2 R24520.2 R24521.2 R24522.2 R24523.2 R24524.2 R24525.2 R24526.2 R24527.2 R24528.2 R24529.2 R24530.2 R24531.2 R24532.2 R24533.2 R24534.2 R24535.2 R24536.2 R24537.2 R24538.2 R24539.2 R24540.2 R24541.2 R24542.2 R24543.2 R24544.2 R24545.2 R24546.2 R24547.2 R24548.2 R24549.2 R24550.2 R24551.2 R24552.2 R24553.2 R24554.2 R24555.2 R24556.2 R24557.2 R24558.2 R24559.2 R24560.2 R24561.2 R24562.2 R24563.2 R24564.2 R24565.2 R24566.2 R24567.2 R24568.2 R24569.2 R24570.2 R24571.2 R24572.2 R24573.2 R24574.2 R24575.2 R24576.2 R24577.2 R24578.2 R24579.2 R24580.2 R24581.2 R24582.2 R24583.2 R24584.2 R24585.2 R24586.2 R24587.2 R24588.2 R24589.2 R24590.2 R24591.2 R24592.2 R24593.2 R24594.2 R24595.2 R24596.2 R24597.2 R24598.2 R24599.2 R24600.2 R24601.1 R24602.1 R24603.1 R24604.1 R24605.1 R24606.1 R24607.1 R24608.1 R24609.1 R24610.1 R24611.1 R24612.1 R24613.1 R24614.1 R24615.1 R24616.1 R24617.1 R24618.1 R24619.1 R24620.1 R24621.1 R24622.1 R24623.1 R24624.1 R24625.1 R24626.1 R24627.1 R24628.1 R24629.1 R24630.1 R24631.1 R24632.1 R24633.1 R24634.1 R24635.1 R24636.1 R24637.1 R24638.1 R24639.1 R24640.1 R24641.1 R24642.1 R24643.1 R24644.1 R24645.1 R24646.1 R24647.1 R24648.1 R24649.1 R24650.1 R24651.1 R24652.1 R24653.1 R24654.1 R24655.1 R24656.1 R24657.1 R24658.1 R24659.1 R24660.1 R24661.1 R24662.1 R24663.1 R24664.1 R24665.1 R24666.1 R24667.1 R24668.1 R24669.1 R24670.1 R24671.1 R24672.1 R24673.1 R24674.1 R24675.1 R24676.1 R24677.1 R24678.1 R24679.1 R24680.1 R24681.1 R24682.1 R24683.1 R24684.1 R24685.1 R24686.1 R24687.1 R24688.1 R24689.1 R24690.1 R24691.1 R24692.1 R24693.1 R24694.1 R24695.1 R24696.1 R24697.1 R24698.1 R24699.1 R24700.1 R24701.1 R24702.1 R24703.1 R24704.1 R24705.1 R24706.1 R24707.1 R24708.1 R24709.1 R24710.1 R24711.1 R24712.1 R24713.1 R24714.1 R24715.1 R24716.1 R24717.1 R24718.1 R24719.1 R24720.1 R24721.1 R24722.1 R24723.1 R24724.1 R24725.1 R24726.1 R24727.1 R24728.1 R24729.1 R24730.1 R24731.1 R24732.1 R24733.1 R24734.1 R24735.1 R24736.1 R24737.1 R24738.1 R24739.1 R24740.1 R24741.1 R24742.1 R24743.1 R24744.1 R24745.1 R24746.1 R24747.1 R24748.1 R24749.1 R24750.1 R24751.1 R24752.1 R24753.1 R24754.1 R24755.1 R24756.1 R24757.1 R24758.1 R24759.1 R24760.1 R24761.1 R24762.1 R24763.1 R24764.1 R24765.1 R24766.1 R24767.1 R24768.1 R24769.1 R24770.1 R24771.1 R24772.1 R24773.1 R24774.1 R24775.1 R24776.1 R24777.1 R24778.1 R24779.1 R24780.1 R24781.1 R24782.1 R24783.1 R24784.1 R24785.1 R24786.1 R24787.1 R24788.1 R24789.1 R24790.1 R24791.1 R24792.1 R24793.1 R24794.1 R24795.1 R24796.1 R24797.1 R24798.1 R24799.1 R24800.1
N$132: R24601.2 R24602.2 R24603.2 R24604.2 R24605.2 R24606.2 R24607.2 R24608.2 R24609.2 R24610.2 R24611.2 R24612.2 R24613.2 R24614.2 R24615.2 R24616.2 R24617.2 R24618.2 R24619.2 R24620.2 R24621.2 R24622.2 R24623.2 R24624.2 R24625.2 R24626.2 R24627.2 R24628.2 R24629.2 R24630.2 R24631.2 R24632.2 R24633.2 R24634.2 R24635.2 R24636.2 R24637.2 R24638.2 R24639.2 R24640.2 R24641.2 R24642.2 R24643.2 R24644.2 R24645.2 R24646.2 R24647.2 R24648.2 R24649.2 R24650.2 R24651.2 R24652.2 R24653.2 R24654.2 R24655.2 R24656.2 R24657.2 R24658.2 R24659.2 R24660.2 R24661.2 R24662.2 R24663.2 R24664.2 R24665.2 R24666.2 R24667.2 R24668.2 R24669.2 R24670.2 R24671.2 R24672.2 R24673.2 R24674.2 R24675.2 R24676.2 R24677.2 R24678.2 R24679.2 R24680.2 R24681.2 R24682.2 R24683.2 R24684.2 R24685.2 R24686.2 R24687.2 R24688.2 R24689.2 R24690.2 R24691.2 R24692.2 R24693.2 R24694.2 R24695.2 R24696.2 R24697.2 R24698.2 R24699.2 R24700.2 R24701.2 R24702.2 R24703.2 R24704.2 R24705.2 R24706.2 R24707.2 R24708.2 R24709.2 R24710.2 R24711.2 R24712.2 R24713.2 R24714.2 R24715.2 R24716.2 R24717.2 R24718.2 R24719.2 R24720.2 R24721.2 R24722.2 R24723.2 R24724.2 R24725.2 R24726.2 R24727.2 R24728.2 R24729.2 R24730.2 R24731.2 R24732.2 R24733.2 R24734.2 R24735.2 R24736.2 R24737.2 R24738.2 R24739.2 R24740.2 R24741.2 R24742.2 R24743.2 R24744.2 R24745.2 R24746.2 R24747.2 R24748.2 R24749.2 R24750.2 R24751.2 R24752.2 R24753.2 R24754.2 R24755.2 R24756.2 R24757.2 R24758.2 R24759.2 R24760.2 R24761.2 R24762.2 R24763.2 R24764.2 R24765.2 R24766.2 R24767.2 R24768.2 R24769.2 R24770.2 R24771.2 R24772.2 R24773.2 R24774.2 R24775.2 R24776.2 R24777.2 R24778.2 R24779.2 R24780.2 R24781.2 R24782.2 R24783.2 R24784.2 R24785.2 R24786.2 R24787.2 R24788.2 R24789.2 R24790.2 R24791.2 R24792.2 R24793.2 R24794.2 R24795.2 R24796.2 R24797.2 R24798.2 R24799.2 R24800.2 R24801.1 R24802.1 R24803.1 R24804.1 R24805.1 R24806.1 R24807.1 R24808.1 R24809.1 R24810.1 R24811.1 R24812.1 R24813.1 R24814.1 R24815.1 R24816.1 R24817.1 R24818.1 R24819.1 R24820.1 R24821.1 R24822.1 R24823.1 R24824.1 R24825.1 R24826.1 R24827.1 R24828.1 R24829.1 R24830.1 R24831.1 R24832.1 R24833.1 R24834.1 R24835.1 R24836.1 R24837.1 R24838.1 R24839.1 R24840.1 R24841.1 R24842.1 R24843.1 R24844.1 R24845.1 R24846.1 R24847.1 R24848.1 R24849.1 R24850.1 R24851.1 R24852.1 R24853.1 R24854.1 R24855.1 R24856.1 R24857.1 R24858.1 R24859.1 R24860.1 R24861.1 R24862.1 R24863.1 R24864.1 R24865.1 R24866.1 R24867.1 R24868.1 R24869.1 R24870.1 R24871.1 R24872.1 R24873.1 R24874.1 R24875.1 R24876.1 R24877.1 R24878.1 R24879.1 R24880.1 R24881.1 R24882.1 R24883.1 R24884.1 R24885.1 R24886.1 R24887.1 R24888.1 R24889.1 R24890.1 R24891.1 R24892.1 R24893.1 R24894.1 R24895.1 R24896.1 R24897.1 R24898.1 R24899.1 R24900.1 R24901.1 R24902.1 R24903.1 R24904.1 R24905.1 R24906.1 R24907.1 R24908.1 R24909.1 R24910.1 R24911.1 R24912.1 R24913.1 R24914.1 R24915.1 R24916.1 R24917.1 R24918.1 R24919.1 R24920.1 R24921.1 R24922.1 R24923.1 R24924.1 R24925.1 R24926.1 R24927.1 R24928.1 R24929.1 R24930.1 R24931.1 R24932.1 R24933.1 R24934.1 R24935.1 R24936.1 R24937.1 R24938.1 R24939.1 R24940.1 R24941.1 R24942.1 R24943.1 R24944.1 R24945.1 R24946.1 R24947.1 R24948.1 R24949.1 R24950.1 R24951.1 R24952.1 R24953.1 R24954.1 R24955.1 R24956.1 R24957.1 R24958.1 R24959.1 R24960.1 R24961.1 R24962.1 R24963.1 R24964.1 R24965.1 R24966.1 R24967.1 R24968.1 R24969.1 R24970.1 R24971.1 R24972.1 R24973.1 R24974.1 R24975.1 R24976.1 R24977.1 R24978.1 R24979.1 R24980.1 R24981.1 R24982.1 R24983.1 R24984.1 R24985.1 R24986.1 R24987.1 R24988.1 R24989.1 R24990.1 R24991.1 R24992.1 R24993.1 R24994.1 R24995.1 R24996.1 R24997.1 R24998.1 R24999.1 R25000.1